# EasyEDA Pro project Project_first.eprj, schematic Schematic7

## Sheets
1 P1: Create Date: 2024-06-03; Page Name: P1; Project Name: Project_first; Schematic Name: Schematic7; Update Date: 2024-06-17; Company: 嘉立创EDA; Page Size: A4; Version: V1.0
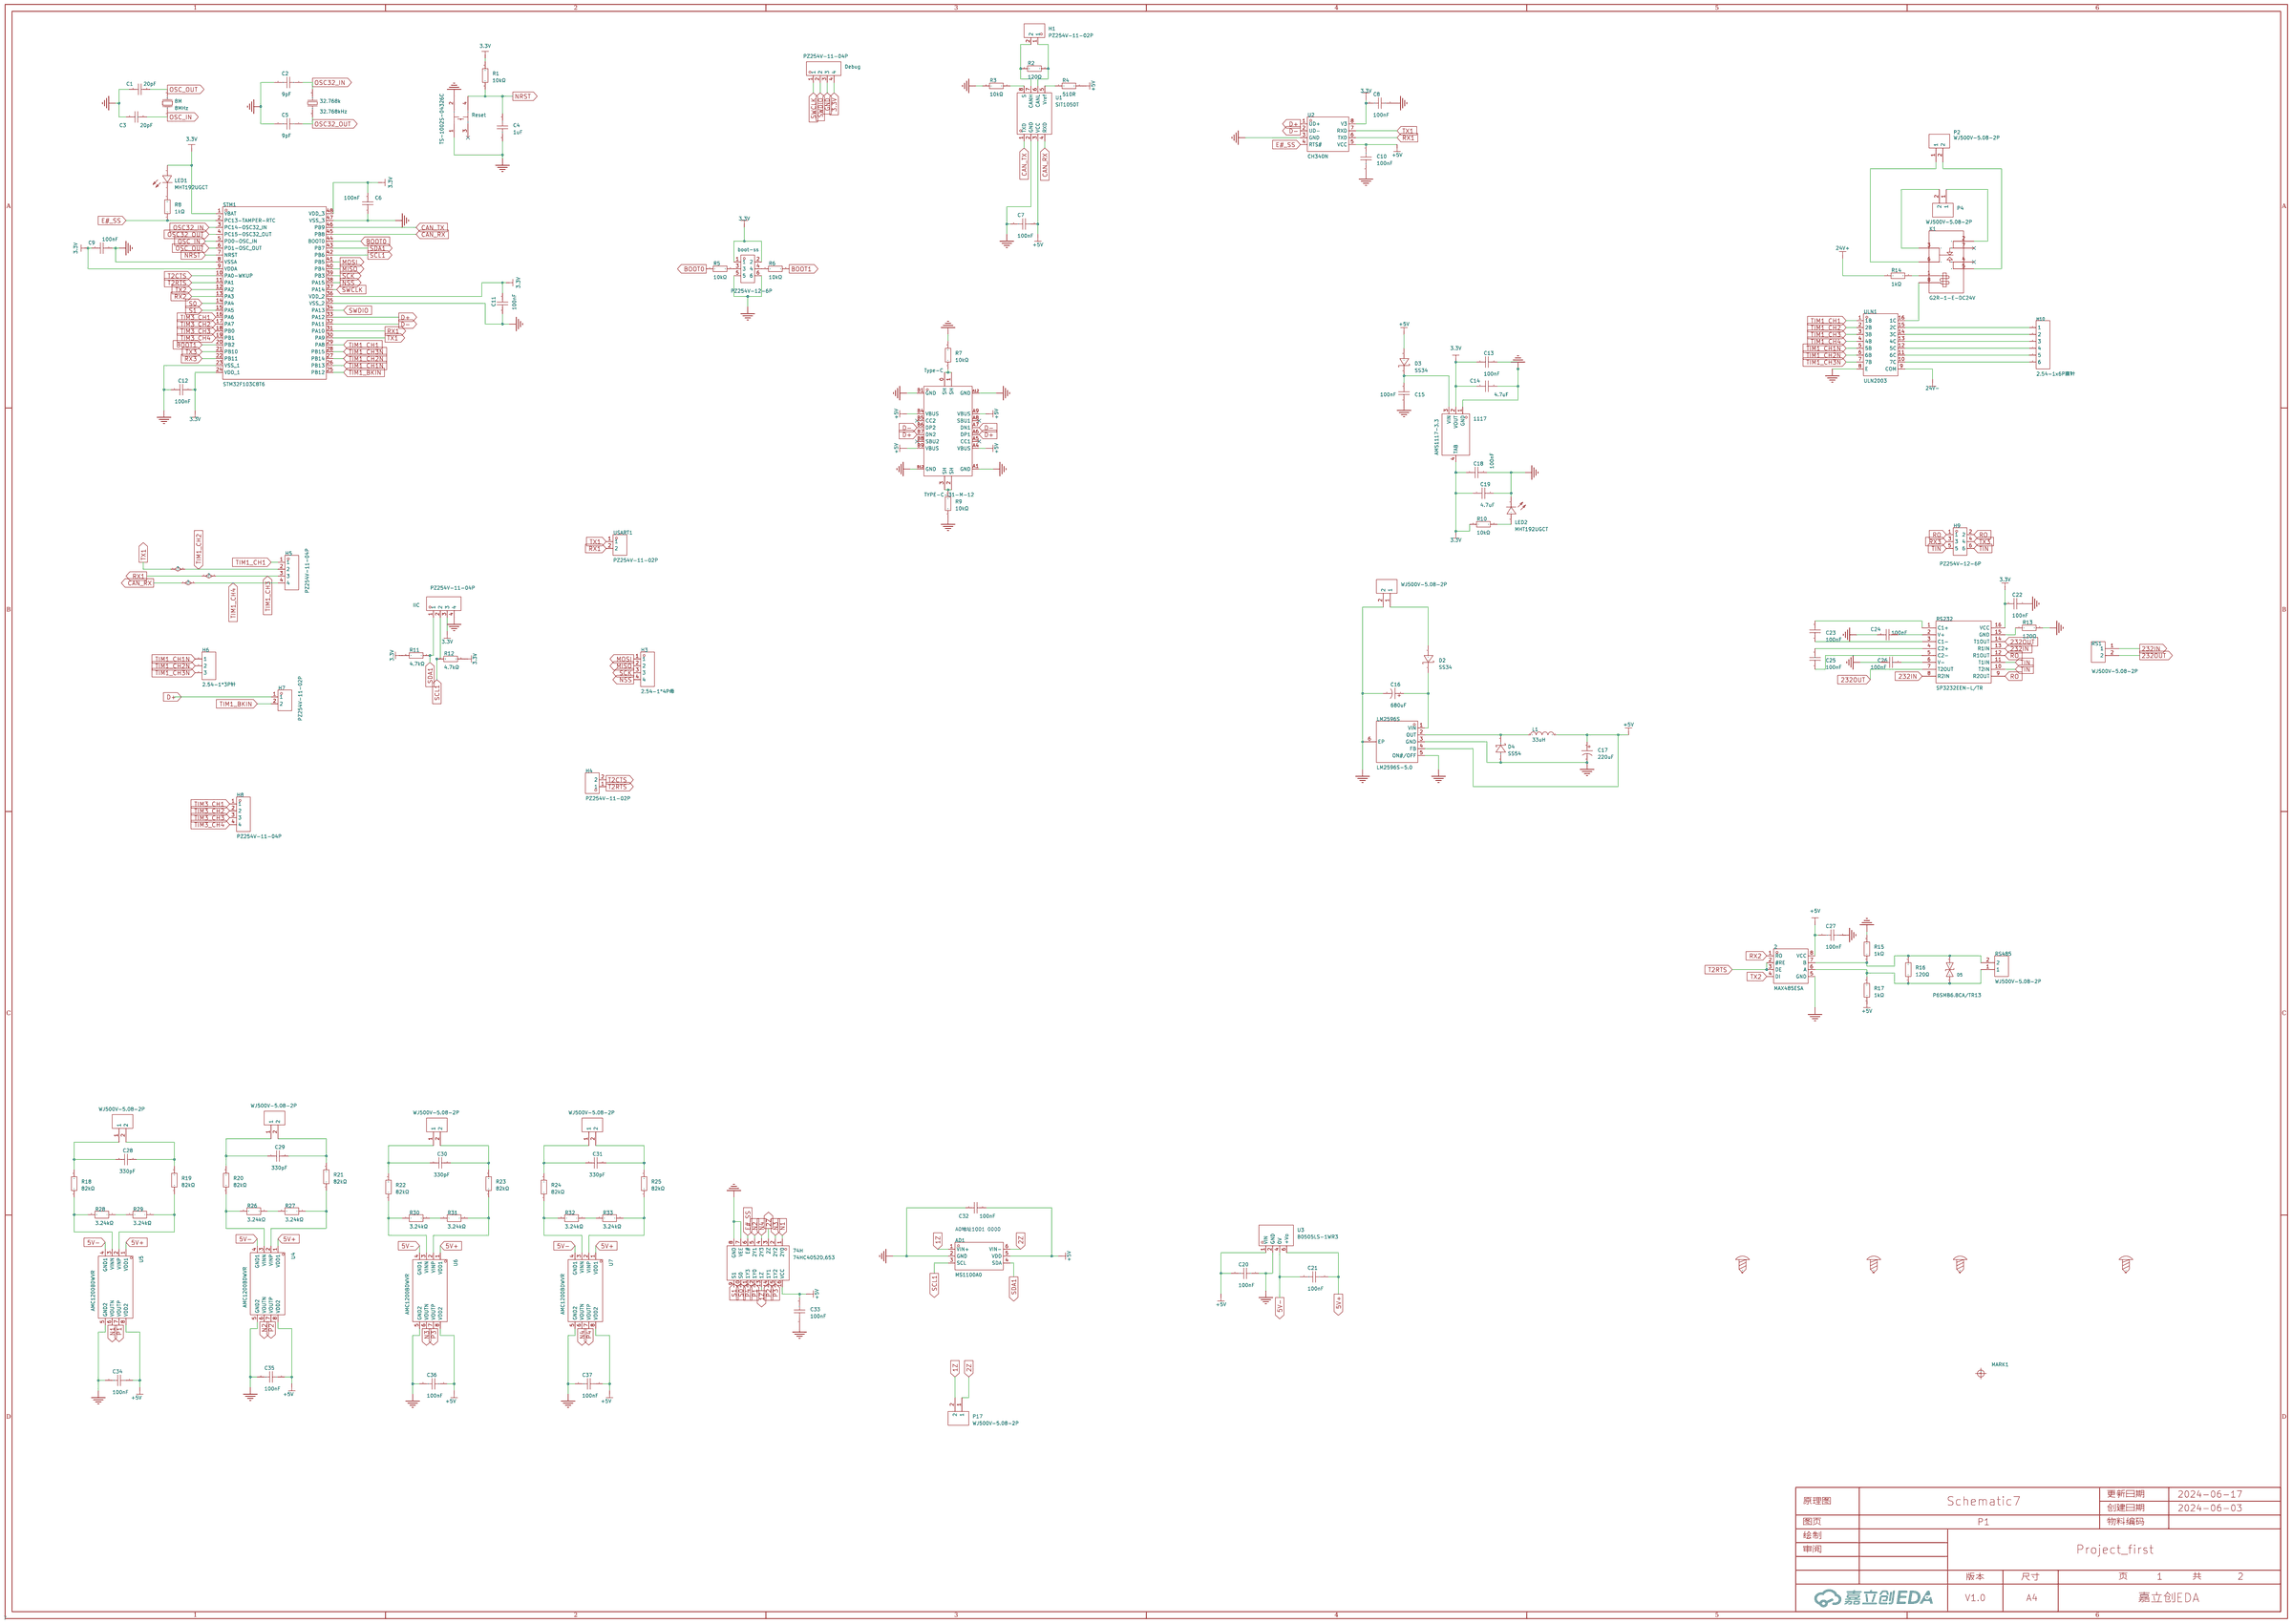
[diagram p7: P1]
2 P2: Create Date: 2024-06-07; Page Name: P2; Update Date: 2024-06-07
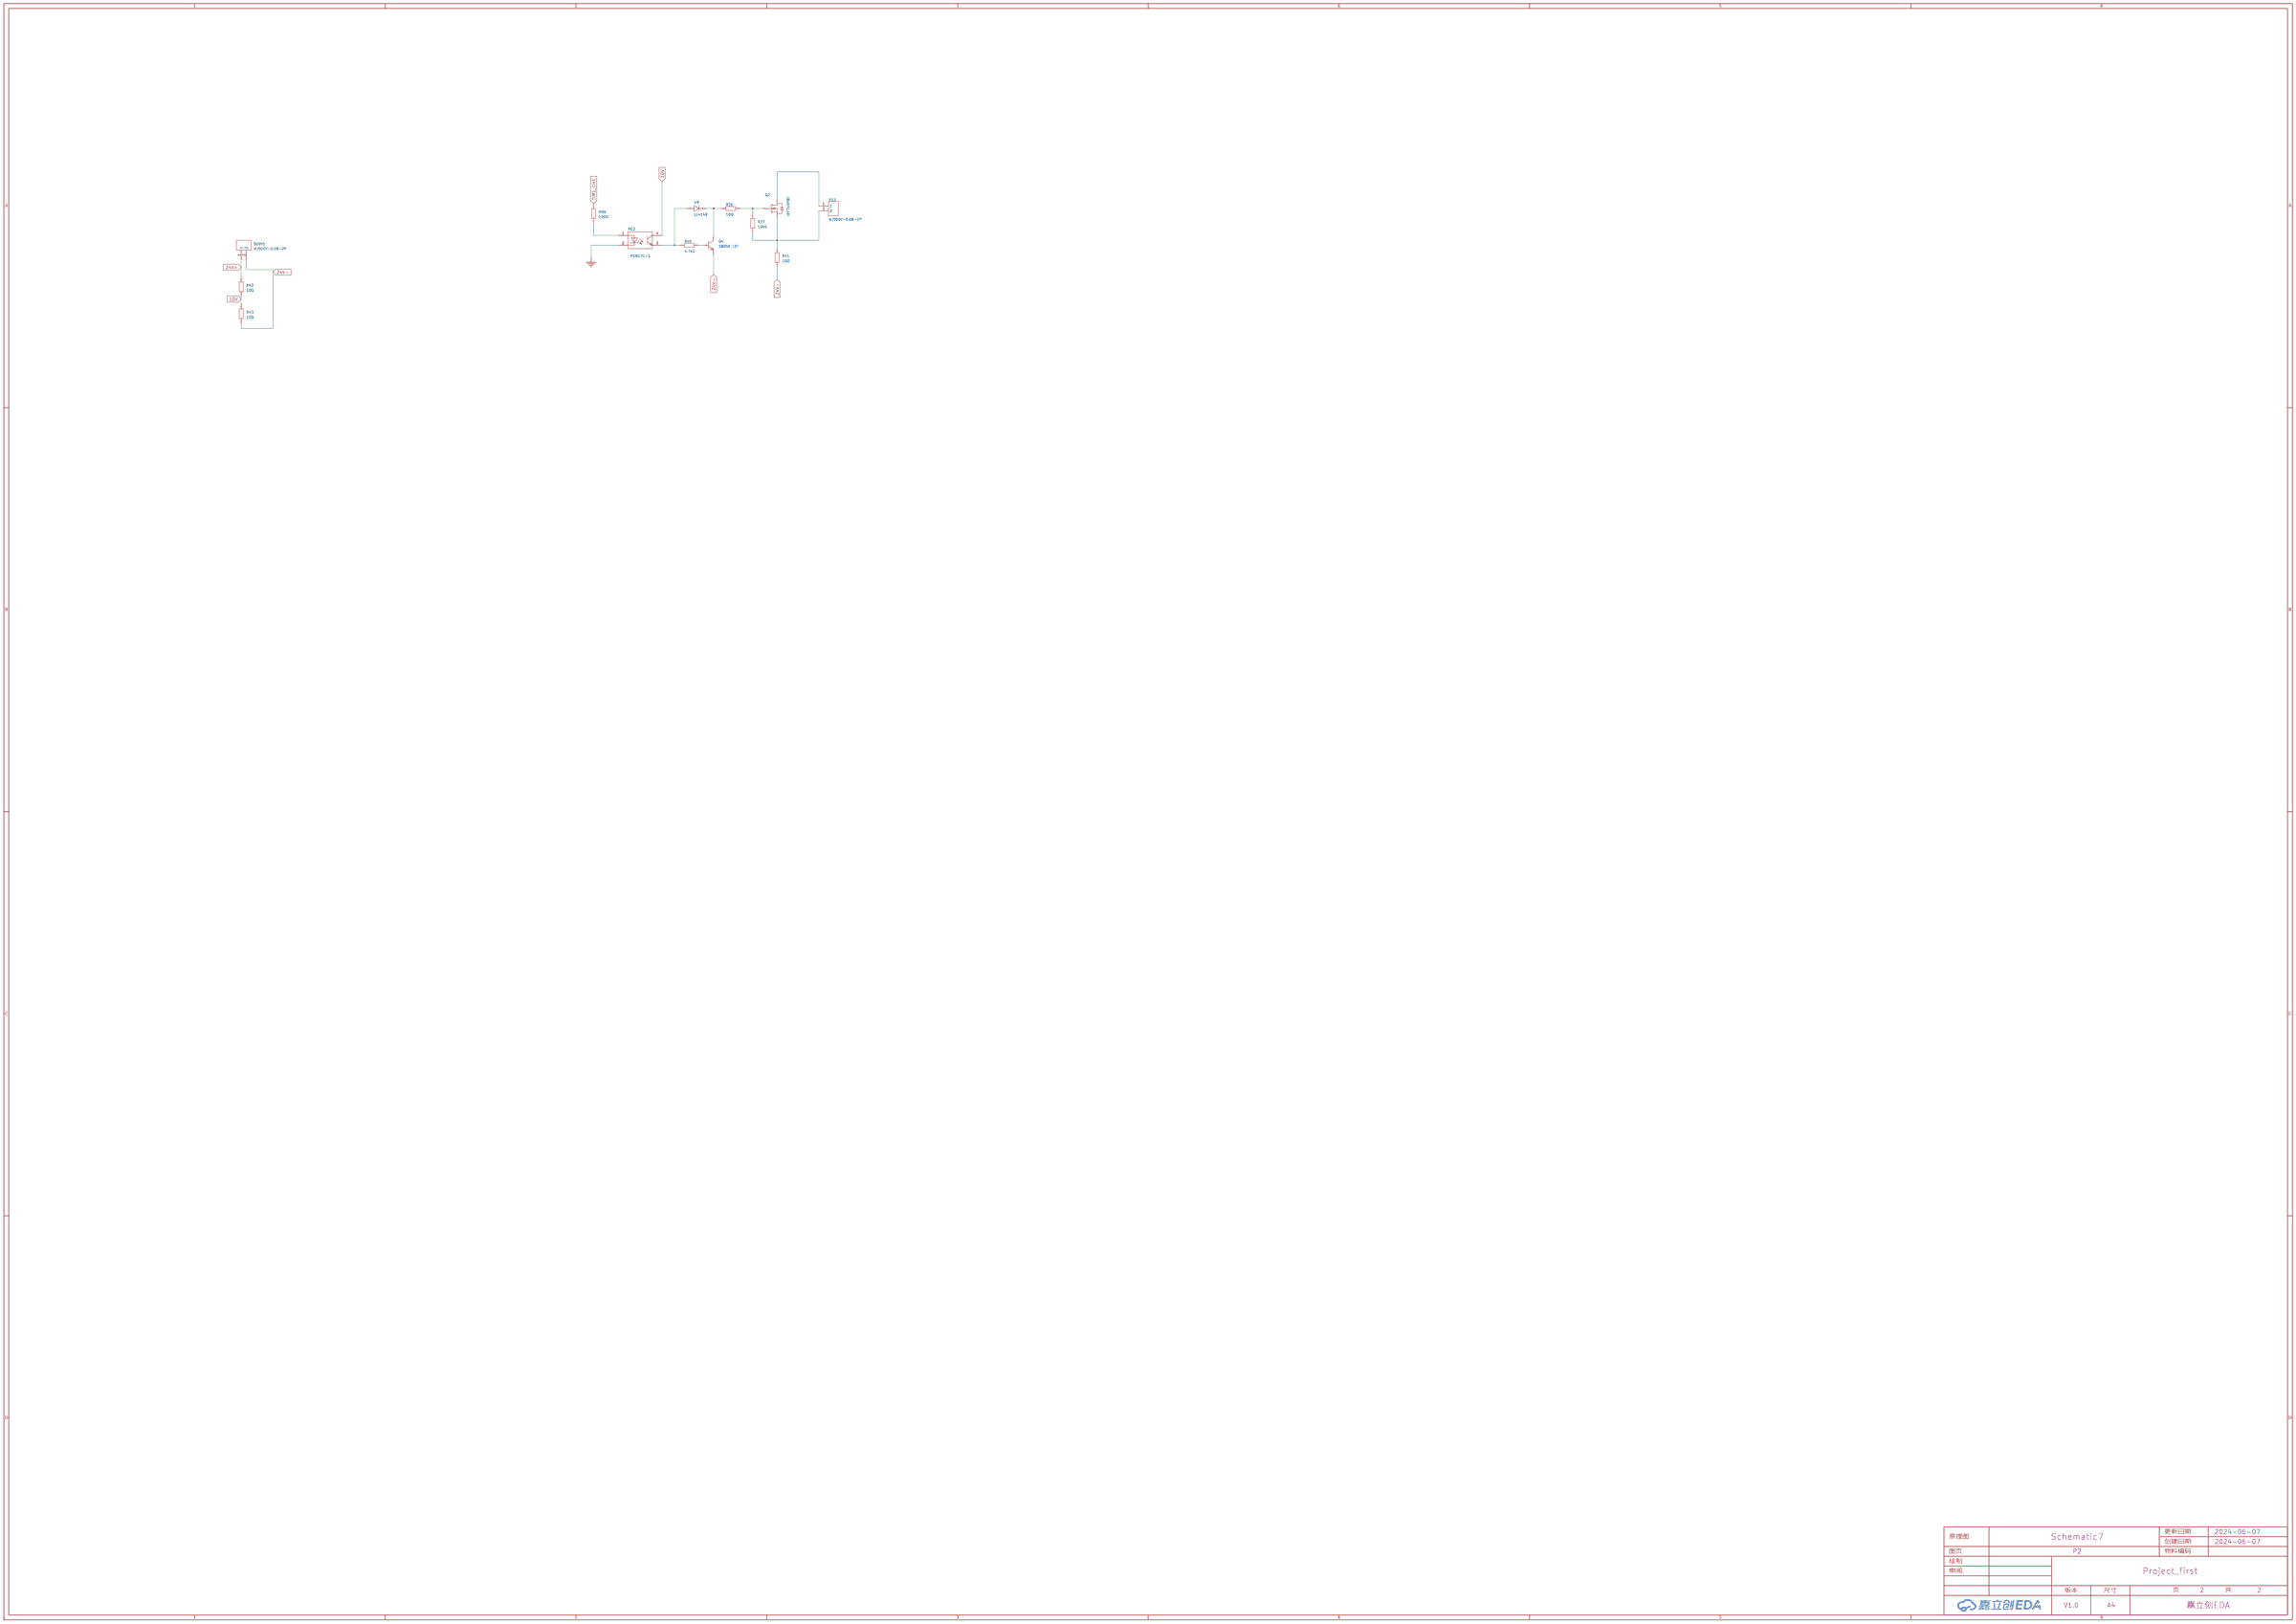
[diagram p8: P2]

## Parts
sheet P1
2  MAX485ESA  [SOP-8_L5.0-W4.0-P1.27-LS6.0-BL]
8M  8MHz  [HC-49US_L11.5-W4.5-P4.88]
24V  WJ500V-5.08-2P  [CONN-TH_2P-P5.00_WJ500V-5.08-2P]
32.768k  32.768kHz  [FC-135R_L3.2-W1.5]
74H  74HC4052D,653  [SOIC-16_L9.9-W3.9-P1.27-LS6.0-BL]
1117  AMS1117-3.3  [SOT-223-3_L6.5-W3.5-P3.05-LS7.0]
AD1  MS1100A0  [SOT-23-6_L2.9-W1.6-P0.95-LS2.8-BR]
boot-ss  PZ254V-12-6P  [HDR-TH_6P-P2.54-V-M-R2-C3-S2.54]
C1  20pF  [C0805]
C2  9pF  [C0805]
C3  20pF  [C0805]
C4  1uF  [C0805]
C5  9pF  [C0805]
C6  100nF  [C0805]
C7  100nF  [C0603]
C8  100nF  [C0603]
C9  100nF  [C0603]
C10  100nF  [C0603]
C11  100nF  [C0603]
C12  100nF  [C0603]
C13  100nF  [C0603]
C14  4.7uF  [C0603]
C15  100nF  [C0603]
C16  680uF  [CAP-TH_BD12.5-P5.00-D0.6-FD]
C17  220uF  [CAP-TH_BD6.3-P2.50-D1.0-FD]
C18  100nF  [C0603]
C19  4.7uF  [C0603]
C20  100nF  [C0603]
C21  100nF  [C0603]
C22  100nF  [C0805]
C23  100nF  [C0805]
C24  100nF  [C0805]
C25  100nF  [C0805]
C26  100nF  [C0805]
C27  100nF  [C0603]
C28  330pF  [C0603]
C29  330pF  [C0603]
C30  330pF  [C0603]
C31  330pF  [C0603]
C32  100nF  [C0603]
C33  100nF  [C0603]
C34  100nF  [C0603]
C35  100nF  [C0603]
C36  100nF  [C0603]
C37  100nF  [C0603]
D2  SS34  [SMA_L4.3-W2.6-LS5.2-RD]
D3  SS34  [SMA_L4.3-W2.6-LS5.2-RD]
D4  SS54  [SMA_L4.3-W2.6-LS5.0-FD]
D5  P6SMB6.8CA/TR13  [SMB_L4.6-W3.6-LS5.3-BI]
Debug  PZ254V-11-04P  [HDR-TH_4P-P2.54-V-M]
H1  PZ254V-11-02P  [HDR-TH_2P-P2.54-V-M]
H3  2.54-1*4P母  [HDR-TH_4P-P2.54-V-F]
H4  PZ254V-11-02P  [HDR-TH_2P-P2.54-V-M]
H5  PZ254V-11-04P  [HDR-TH_4P-P2.54-V-M]
H6  2.54-1*3P针  [HDR-TH_3P-P2.54-V-M-1]
H7  PZ254V-11-02P  [HDR-TH_2P-P2.54-V-M]
H8  PZ254V-11-04P  [HDR-TH_4P-P2.54-V-M]
H9  PZ254V-12-6P  [HDR-TH_6P-P2.54-V-M-R2-C3-S2.54]
H10  2.54-1x6P直针  [HDR-TH_6P-P2.54-V-M-1]
IIC  PZ254V-11-04P  [HDR-TH_4P-P2.54-V-M]
K1  G2R-1-E-DC24V  [RELAY-TH_JQX-115F-XXX-2ZXX]
L1  33uH  [IND-SMD_L3.5-W3.0]
LED1  MHT192UGCT  [LED0603-RD_GREEN]
LED2  MHT192UGCT  [LED0603-RD_GREEN]
LM2596S  LM2596S-5.0  [TO-263-5_L10.2-W8.9-P1.70-BR]
MARK1  -  [Mark-Point-1mm]  (no BOM)
P2  WJ500V-5.08-2P  [CONN-TH_2P-P5.00_WJ500V-5.08-2P]
P4  WJ500V-5.08-2P  [CONN-TH_2P-P5.00_WJ500V-5.08-2P]
P6  WJ500V-5.08-2P  [CONN-TH_2P-P5.00_WJ500V-5.08-2P]
P7  WJ500V-5.08-2P  [CONN-TH_2P-P5.00_WJ500V-5.08-2P]
P8  WJ500V-5.08-2P  [CONN-TH_2P-P5.00_WJ500V-5.08-2P]
P9  WJ500V-5.08-2P  [CONN-TH_2P-P5.00_WJ500V-5.08-2P]
P17  WJ500V-5.08-2P  [CONN-TH_2P-P5.00_WJ500V-5.08-2P]
R1  10kΩ  [R0805]
R2  120Ω  [R0603]
R3  10kΩ  [R0603]
R4  510R  [R0805]
R5  10kΩ  [R0805]
R6  10kΩ  [R0805]
R7  10kΩ  [R0805]
R8  1kΩ  [R0805]
R9  10kΩ  [R0805]
R10  10kΩ  [R0805]
R11  4.7kΩ  [R0805]
R12  4.7kΩ  [R0805]
R13  120Ω  [R0603]
R14  1kΩ  [R0805]
R15  1kΩ  [R0805]
R16  120Ω  [R0603]
R17  1kΩ  [R0805]
R18  82kΩ  [R1206]
R19  82kΩ  [R1206]
R20  82kΩ  [R1206]
R21  82kΩ  [R1206]
R22  82kΩ  [R1206]
R23  82kΩ  [R1206]
R24  82kΩ  [R1206]
R25  82kΩ  [R1206]
R26  3.24kΩ  [R1206]
R27  3.24kΩ  [R1206]
R28  3.24kΩ  [R1206]
R29  3.24kΩ  [R1206]
R30  3.24kΩ  [R1206]
R31  3.24kΩ  [R1206]
R32  3.24kΩ  [R1206]
R33  3.24kΩ  [R1206]
Reset  TS-1002S-04326C  [KEY-SMD_4P-L6.0-W6.0-P4.50-LS9.0]
RS1  WJ500V-5.08-2P  [CONN-TH_2P-P5.00_WJ500V-5.08-2P]
RS232  SP3232EEN-L/TR  [SOIC-16_L9.9-W3.9-P1.27-LS6.0-BL]
RS485  WJ500V-5.08-2P  [CONN-TH_2P-P5.00_WJ500V-5.08-2P]
SCREW1  -  [M3螺丝]
SCREW2  -  [M3螺丝]
SCREW3  -  [M3螺丝]
SCREW4  -  [M3螺丝]
STM1  STM32F103C8T6  [LQFP-48_L7.0-W7.0-P0.50-LS9.0-BL]
Type-C  TYPE-C-31-M-12  [USB-C_SMD-TYPE-C-31-M-12]
U1  SIT1050T  [SO-8_L4.9-W3.9-P1.27-LS5.9-BL]
U2  CH340N  [SOP-8_L4.9-W3.9-P1.27-LS6.0-BL]
U3  B0505LS-1WR3  [PWRM-TH_BXXXXLS-1WR3]
U4  AMC1200BDWVR  [SOIC-8_L5.9-W7.5-P1.27-LS11.5-BL]
U5  AMC1200BDWVR  [SOIC-8_L5.9-W7.5-P1.27-LS11.5-BL]
U6  AMC1200BDWVR  [SOIC-8_L5.9-W7.5-P1.27-LS11.5-BL]
U7  AMC1200BDWVR  [SOIC-8_L5.9-W7.5-P1.27-LS11.5-BL]
ULN1  ULN2003  [SOP-16_L9.9-W3.9-P1.27-LS6.0-BL]
USART1  PZ254V-11-02P  [HDR-TH_2P-P2.54-V-M]
sheet P2
500V1  WJ500V-5.08-2P  [CONN-TH_2P-P5.00_WJ500V-5.08-2P]
P12  WJ500V-5.08-2P  [CONN-TH_2P-P5.00_WJ500V-5.08-2P]
PC2  PC817C-S  [SOP-4_L6.5-W4.6-P2.54-LS10.3-TL]
Q2  IRF740PBF  [TO-220-3_L10.0-W4.5-P2.54-L]
Q4  S8050 J3Y  [SOT-23-3_L3.0-W1.7-P0.95-LS2.9-BR]
R36  10Ω  [R0805]
R37  10kΩ  [R0805]
R40  4.7kΩ  [R0805]
R41  10Ω  [R2512]
R42  10Ω  [R2512]
R43  10Ω  [R2512]
R99  120Ω  [R0805]
U9  LL4148  [LL-34_L3.5-W1.5-RD]

## Library data of the parts
2 = MAX485ESA_C668206: Supplier Part: C668206; Manufacturer: UMW(友台半导体); Supplier Footprint: SOP-8; JLCPCB Part Class: Extended Part; Datasheet: https://atta.szlcsc.com/upload/public/pdf/source/20231109/489730AE87B90C4B6B8CE65C07B1054C.pdf; Supplier: LCSC
8M = TAXD8M2GLFBET2T: 晶振类型:直插晶振;频率:8MHz;常温频差:±30ppm;外接负载电容:20pF;频率稳定度(全温):±30ppm;; LCSC Part Name: 8MHz ±30ppm 20pF; Supplier Part: C107425; Manufacturer: YJX(雅晶鑫); Supplier Footprint: HC-49S; JLCPCB Part Class: Extended Part; Datasheet: https://atta.szlcsc.com/upload/public/pdf/source/20170914/C127676_1505359415156967690.pdf; Supplier: LCSC; Crystal Type: 直插晶振; Normal temperature Frequency Tolerance: ±30ppm; External load capacitor: 20pF; Frequency Stability(Full temperature range): ±30ppm; Equivalent Series Resistance (ESR): 80Ω; Operating Temperature: -20℃~+70℃
24V 500V1 P2 P4 P6-P9 P12 P17 RS1 RS485 = WJ500V-5.08-2P: 结构:1x2P;间距:5.08mm;颜色:绿色;安装方式:直插;额定电流:18A;额定电压:250V;排数:1;线规 - AWG:14~30;线规 - 平方毫米:2.5;每排PIN数:2;触头材质:-;触头镀层:-;工作温度范围:-40℃~+105℃;焊接温度(最大值):-;; LCSC Part Name: 1x2P 5.08mm 直插 排数:1 每排P数:2; Supplier Part: C8465; Manufacturer: KANGNEX(康奈克斯电气); Supplier Footprint: 插件,P=5.08mm; JLCPCB Part Class: Extended Part; Datasheet: https://atta.szlcsc.com/upload/public/pdf/source/20191225/C8465_02D34CE5B5B4A53DF5891601D97FA9F4.pdf; Supplier: LCSC; Structure: 1x2P; Pitch: 5.08mm; Color: 绿色; Mounting Style: 直插; Current Rating (Max): 18A; Voltage Rating (Max): 250V; Number of Pins: 2P; Number of Rows: 1; Wire Gauge - AWG: 14~30; Wire Gauge - mm2: 2.5; Number of PINs Per Row: 2; Operating Temperature Range: -40℃~+105℃; Screw Specification: M2.5
32.768k = Q13FC13500004_C32346: 晶振类型:贴片晶振;频率:32.768kHz;常温频差:±20ppm;外接负载电容:12.5pF;; LCSC Part Name: 32.768kHz ±20ppm 12.5pF; Supplier Part: C32346; Manufacturer: EPSON(爱普生); Manufacturer Part: Q13FC13500004; Supplier Footprint: SMD3215-2P; JLCPCB Part Class: Basic Part; Datasheet: https://atta.szlcsc.com/upload/public/pdf/source/20240418/0E0FF5F0356BA3753F616001439D1416.pdf; Supplier: LCSC; Crystal Type: 贴片晶振; Normal temperature Frequency Tolerance: ±20ppm; External load capacitor: 12.5pF; Equivalent Series Resistance (ESR): 70kΩ; Operating Temperature: -40℃~+85℃
74H = 74HC4052D,653: 开关电路:单刀四掷(SP4T);通道数:2;导通电阻(Ron@VCC):150Ω;; LCSC Part Name: 双4通道模拟复用器 解复用器; Supplier Part: C11350; Manufacturer: Nexperia(安世); Supplier Footprint: SOIC-16; JLCPCB Part Class: Extended Part; Datasheet: https://atta.szlcsc.com/upload/public/pdf/source/20130225/1457706594415.pdf; Supplier: LCSC; Switch Circuit: 单刀四掷(SP4T); Number of Channels: 2; Supply Voltage: 2V~10V; Turn-on time: 58ns; On-State Resistance (Max): 150Ω; Turn-off time: 48ns; Check: true
1117 = AMS1117-3.3_C5250992: 输出类型：固定 输出极性：正 最大输入电压：18V 输出电压：3.3V 输出电流：1A 电源纹波抑制比(PSRR)：60dB@(120Hz)。当前应用较多领域：三端稳压器，机顶盒; Supplier Part: C5250992; Manufacturer: TWGMC(台湾迪嘉); Supplier Footprint: SOT-223-3L; JLCPCB Part Class: Extended Part; Datasheet: https://atta.szlcsc.com/upload/public/pdf/source/20221109/A58A92B07670E85D28928AE371260E8D.pdf; Supplier: LCSC
AD1 = MS1100A0: 接口:I2C;电源电压:2.7V~5.5V;采样率:240Hz;分辨率:16位;; LCSC Part Name: 1通道 240Hz 16位ADC I2C接口; Supplier Part: C482687; Manufacturer: 杭州瑞盟; Supplier Footprint: SOT-23-6; JLCPCB Part Class: Extended Part; Datasheet: https://atta.szlcsc.com/upload/public/pdf/source/20200115/C482687_AC1DA36C49F76E9B9AAB230F60F7F07C.pdf; Supplier: LCSC; Interface: I2C; differential input: 是; number of channels: 1; Supply Voltage: 2.7V~5.5V; sampling frequency: 240Hz; resolution: 16位; Check: true
boot-ss H9 = PZ254V-12-6P: 插针结构:2x3P;间距:2.54mm;行距:2.54mm;圆针/方针:方针;安装类型:直插;排数:双排;总PIN位数:6P;额定电流:-;额定电压:-;配合针长度:6mm;塑高:2.5mm;端接针长度:3mm;触头材质:黄铜;触头镀层:-;工作温度范围:-40℃~+105℃;颜色:黑色;; LCSC Part Name: 间距:2.54mm 2x3P 直插 方针; Supplier Part: C492420; Manufacturer: XFCN(兴飞); Supplier Footprint: 插件,P=2.54mm; JLCPCB Part Class: Extended Part; Datasheet: https://atta.szlcsc.com/upload/public/pdf/source/20200309/C492420_BAECB307B001054C09D200388220EAE6.pdf; Supplier: LCSC; Pin Structure: 2x3P; Pitch: 2.54mm; Row Spacing: 2.54mm; Circluar Pins/Square Pins: 方针; Mounting Type: 直插; Number of Rows: 双排; Number of Pins: 6P; Length of Mating Pin: 6mm; Insulation Height: 2.5mm; Length of End Connection Pin: 3mm; Contact Material: 黄铜; Operating Temperature Range: -40℃~+105℃; Color: 黑色
C1 C3 = CL21C200JBANNNC: 容值:20pF;精度:±5%;额定电压:50V;材质(温度系数):C0G;; LCSC Part Name: 20pF ±5% 50V; Supplier Part: C1798; Manufacturer: SAMSUNG(三星); Supplier Footprint: 0805; JLCPCB Part Class: Basic Part; Datasheet: https://atta.szlcsc.com/upload/public/pdf/source/20160218/1457707763339.pdf; Supplier: LCSC; Tolerance: ±5%; Voltage Rated: 50V; Temperature Coefficient: C0G
C2 C5 = CC0603CRNPO9BN9R0: 容值:9pF;额定电压:50V;材质(温度系数):NP0;; LCSC Part Name: 9pF 50V; Supplier Part: C282076; Manufacturer: YAGEO(国巨); Supplier Footprint: 0603; JLCPCB Part Class: Extended Part; Datasheet: https://atta.szlcsc.com/upload/public/pdf/source/20181008/C309499_21CC21451B82C39E3D92150FD6B30293.pdf; Supplier: LCSC; Voltage Rated: 50V; Temperature Coefficient: NP0
C4 = CL31B105KBHNNNE: 容值:1uF;精度:±10%;额定电压:50V;材质(温度系数):X7R;; LCSC Part Name: 1uF ±10% 50V; Supplier Part: C1848; Manufacturer: SAMSUNG(三星); Supplier Footprint: 1206; JLCPCB Part Class: Basic Part; Datasheet: https://atta.szlcsc.com/upload/public/pdf/source/20160218/1457707763339.pdf; Supplier: LCSC; Tolerance: ±10%; Voltage Rated: 50V; Temperature Coefficient: X7R
C6 C9 C11-C15 C18 C19 C22-C26 = CC0805KRX7R9BB104: 容值:100nF;精度:±10%;额定电压:50V;材质(温度系数):X7R;; LCSC Part Name: 100nF ±10% 50V; Supplier Part: C49678; Manufacturer: YAGEO(国巨); Supplier Footprint: 0805; JLCPCB Part Class: Basic Part; Datasheet: https://atta.szlcsc.com/upload/public/pdf/source/20180224/C181747_15194369449651363981.pdf; Supplier: LCSC; Tolerance: ±10%; Voltage Rated: 50V; Temperature Coefficient: X7R